# EAGLE schematic Backplane (EAGLE 7.2.0) (continued)
### Nets (continued)

### Notes on the sheet
- Distrabution
- IS | SS | ECU | TS

## Sheet 3 of 4
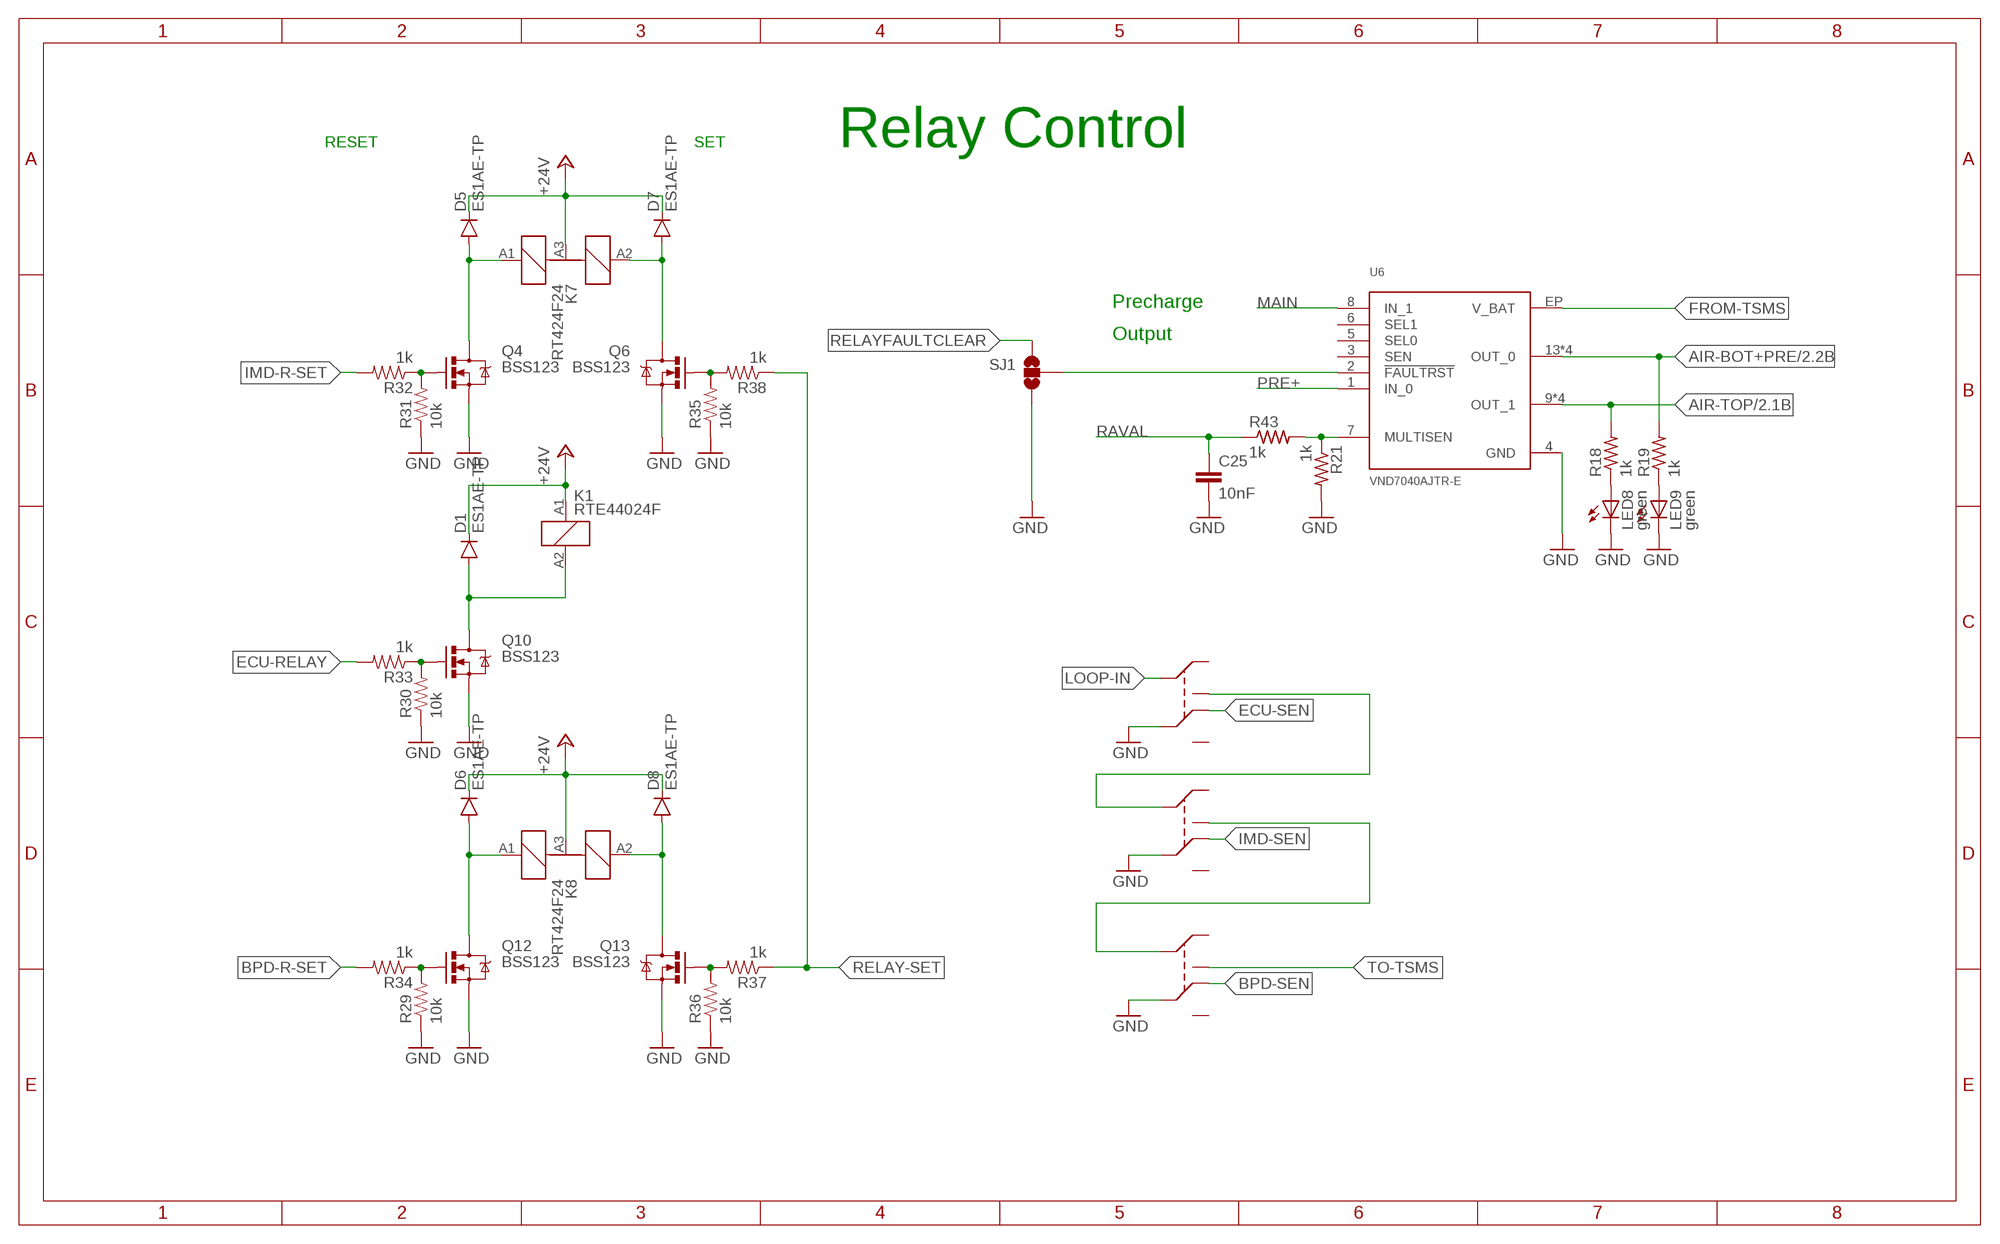
[diagram p3: schematic, sheet 3]

### Parts
C25  10nF  CAP0805  [0805]
D1  ES1AE-TP  DIODESMA-KIT  [SMA-DIODE-KIT]
D5  ES1AE-TP  DIODESMA-KIT  [SMA-DIODE-KIT]
D6  ES1AE-TP  DIODESMA-KIT  [SMA-DIODE-KIT]
D7  ES1AE-TP  DIODESMA-KIT  [SMA-DIODE-KIT]
D8  ES1AE-TP  DIODESMA-KIT  [SMA-DIODE-KIT]
K1  RTE44024F  [RTE44024F]
K7  RT424F24  [RT424F24]
K8  RT424F24  [RT424F24]
LED8  green  LEDCHIP-LED0805  [CHIP-LED0805]
LED9  green  LEDCHIP-LED0805  [CHIP-LED0805]
Q4  BSS123  MOSFET-NCHANNELBSS123LT1G  [SOT23-3]
Q6  BSS123  MOSFET-NCHANNELBSS123LT1G  [SOT23-3]
Q10  BSS123  MOSFET-NCHANNELBSS123LT1G  [SOT23-3]
Q12  BSS123  MOSFET-NCHANNELBSS123LT1G  [SOT23-3]
Q13  BSS123  MOSFET-NCHANNELBSS123LT1G  [SOT23-3]
R18  1k  R-US_R0805  [R0805]
R19  1k  R-US_R0805  [R0805]
R21  1k  R-US_R0805  [R0805]
R29  10k  RESISTOR0805-RES  [0805]
R30  10k  RESISTOR0805-RES  [0805]
R31  10k  RESISTOR0805-RES  [0805]
R32  1k  RESISTOR0805-RES  [0805]
R33  1k  RESISTOR0805-RES  [0805]
R34  1k  RESISTOR0805-RES  [0805]
R35  10k  RESISTOR0805-RES  [0805]
R36  10k  RESISTOR0805-RES  [0805]
R37  1k  RESISTOR0805-RES  [0805]
R38  1k  RESISTOR0805-RES  [0805]
R43  1k  R-US_R0805  [R0805]
SJ1  JUMPER-PAD-3-NOFULL_BOX_SILK  [PAD-JUMPER-3-NO_YES_SILK_FULL_BOX]
U6  VND7040AJTR-E  [SSO-16-POWER]

### Nets
+24V: D1.C D5.C D6.C D7.C D8.C K1.A1(+) K7.A3(-) K8.A3(-) ; also sheet 1,2,4
AIR-BOT+PRE: R19.2 U6.13(OUT_0) U6.14(OUT_0) U6.15(OUT_0) U6.16(OUT_0) ; also sheet 2
AIR-TOP: R18.2 U6.9(OUT_1) U6.10(OUT_1) U6.11(OUT_1) U6.12(OUT_1) ; also sheet 2
BPD-R-SET: R34.2 ; also sheet 2
BPD-SEN: K8.22(NC2) ; also sheet 2
ECU-RELAY: R33.2 ; also sheet 2
ECU-SEN: K1.22(NC2) ; also sheet 2
FROM-TSMS: U6.EP(V_BAT) ; also sheet 2
GND: C25.2 K1.21(C2) K7.21(C2) K8.21(C2) LED8.C LED9.C Q4.2(S) Q6.2(S) Q10.2(S) Q12.2(S) Q13.2(S) R21.2 R29.1 R30.1 R31.1 R35.1 R36.1 SJ1.3 U6.4(GND) ; also sheet 1,2,4
IMD-R-SET: R32.2 ; also sheet 2
IMD-SEN: K7.22(NC2) ; also sheet 2
LOOP-IN: K1.11(C1) ; also sheet 2
MAIN: U6.8(IN_1) ; also sheet 2
N$2: LED8.A R18.1
N$6: Q4.1(G) R31.2 R32.1
N$7: K1.14(NO1) K7.11(C1)
N$10: LED9.A R19.1
N$11: R21.1 R43.2 U6.7(MULTISEN)
N$14: SJ1.2 U6.2(!FAULTRST)
N$15: K7.14(NO1) K8.11(C1)
N$23: Q6.1(G) R35.2 R38.2
N$45: D1.A K1.A2(-) Q10.3(D)
N$47: D5.A K7.A1(+1) Q4.3(D)
N$48: Q10.1(G) R30.2 R33.1
N$49: D7.A K7.A2(+2) Q6.3(D)
N$50: D6.A K8.A1(+1) Q12.3(D)
N$51: D8.A K8.A2(+2) Q13.3(D)
N$55: Q13.1(G) R36.2 R37.2
N$58: Q12.1(G) R29.2 R34.1
PRE+: U6.1(IN_0) ; also sheet 2
RAVAL: C25.1 R43.1
RELAY-SET: R37.1 R38.1 ; also sheet 2
RELAYFAULTCLEAR: SJ1.1
TO-TSMS: K8.14(NO1) ; also sheet 2
Unconnected: K1.12(NC1) K1.24(NO2) K7.12(NC1) K7.24(NO2) K8.12(NC1) K8.24(NO2) U6.3(SEN) U6.5(SEL0) U6.6(SEL1)

### Notes on the sheet
- RESET | SET | Relay Control
- Precharge
- Output

## Sheet 4 of 4
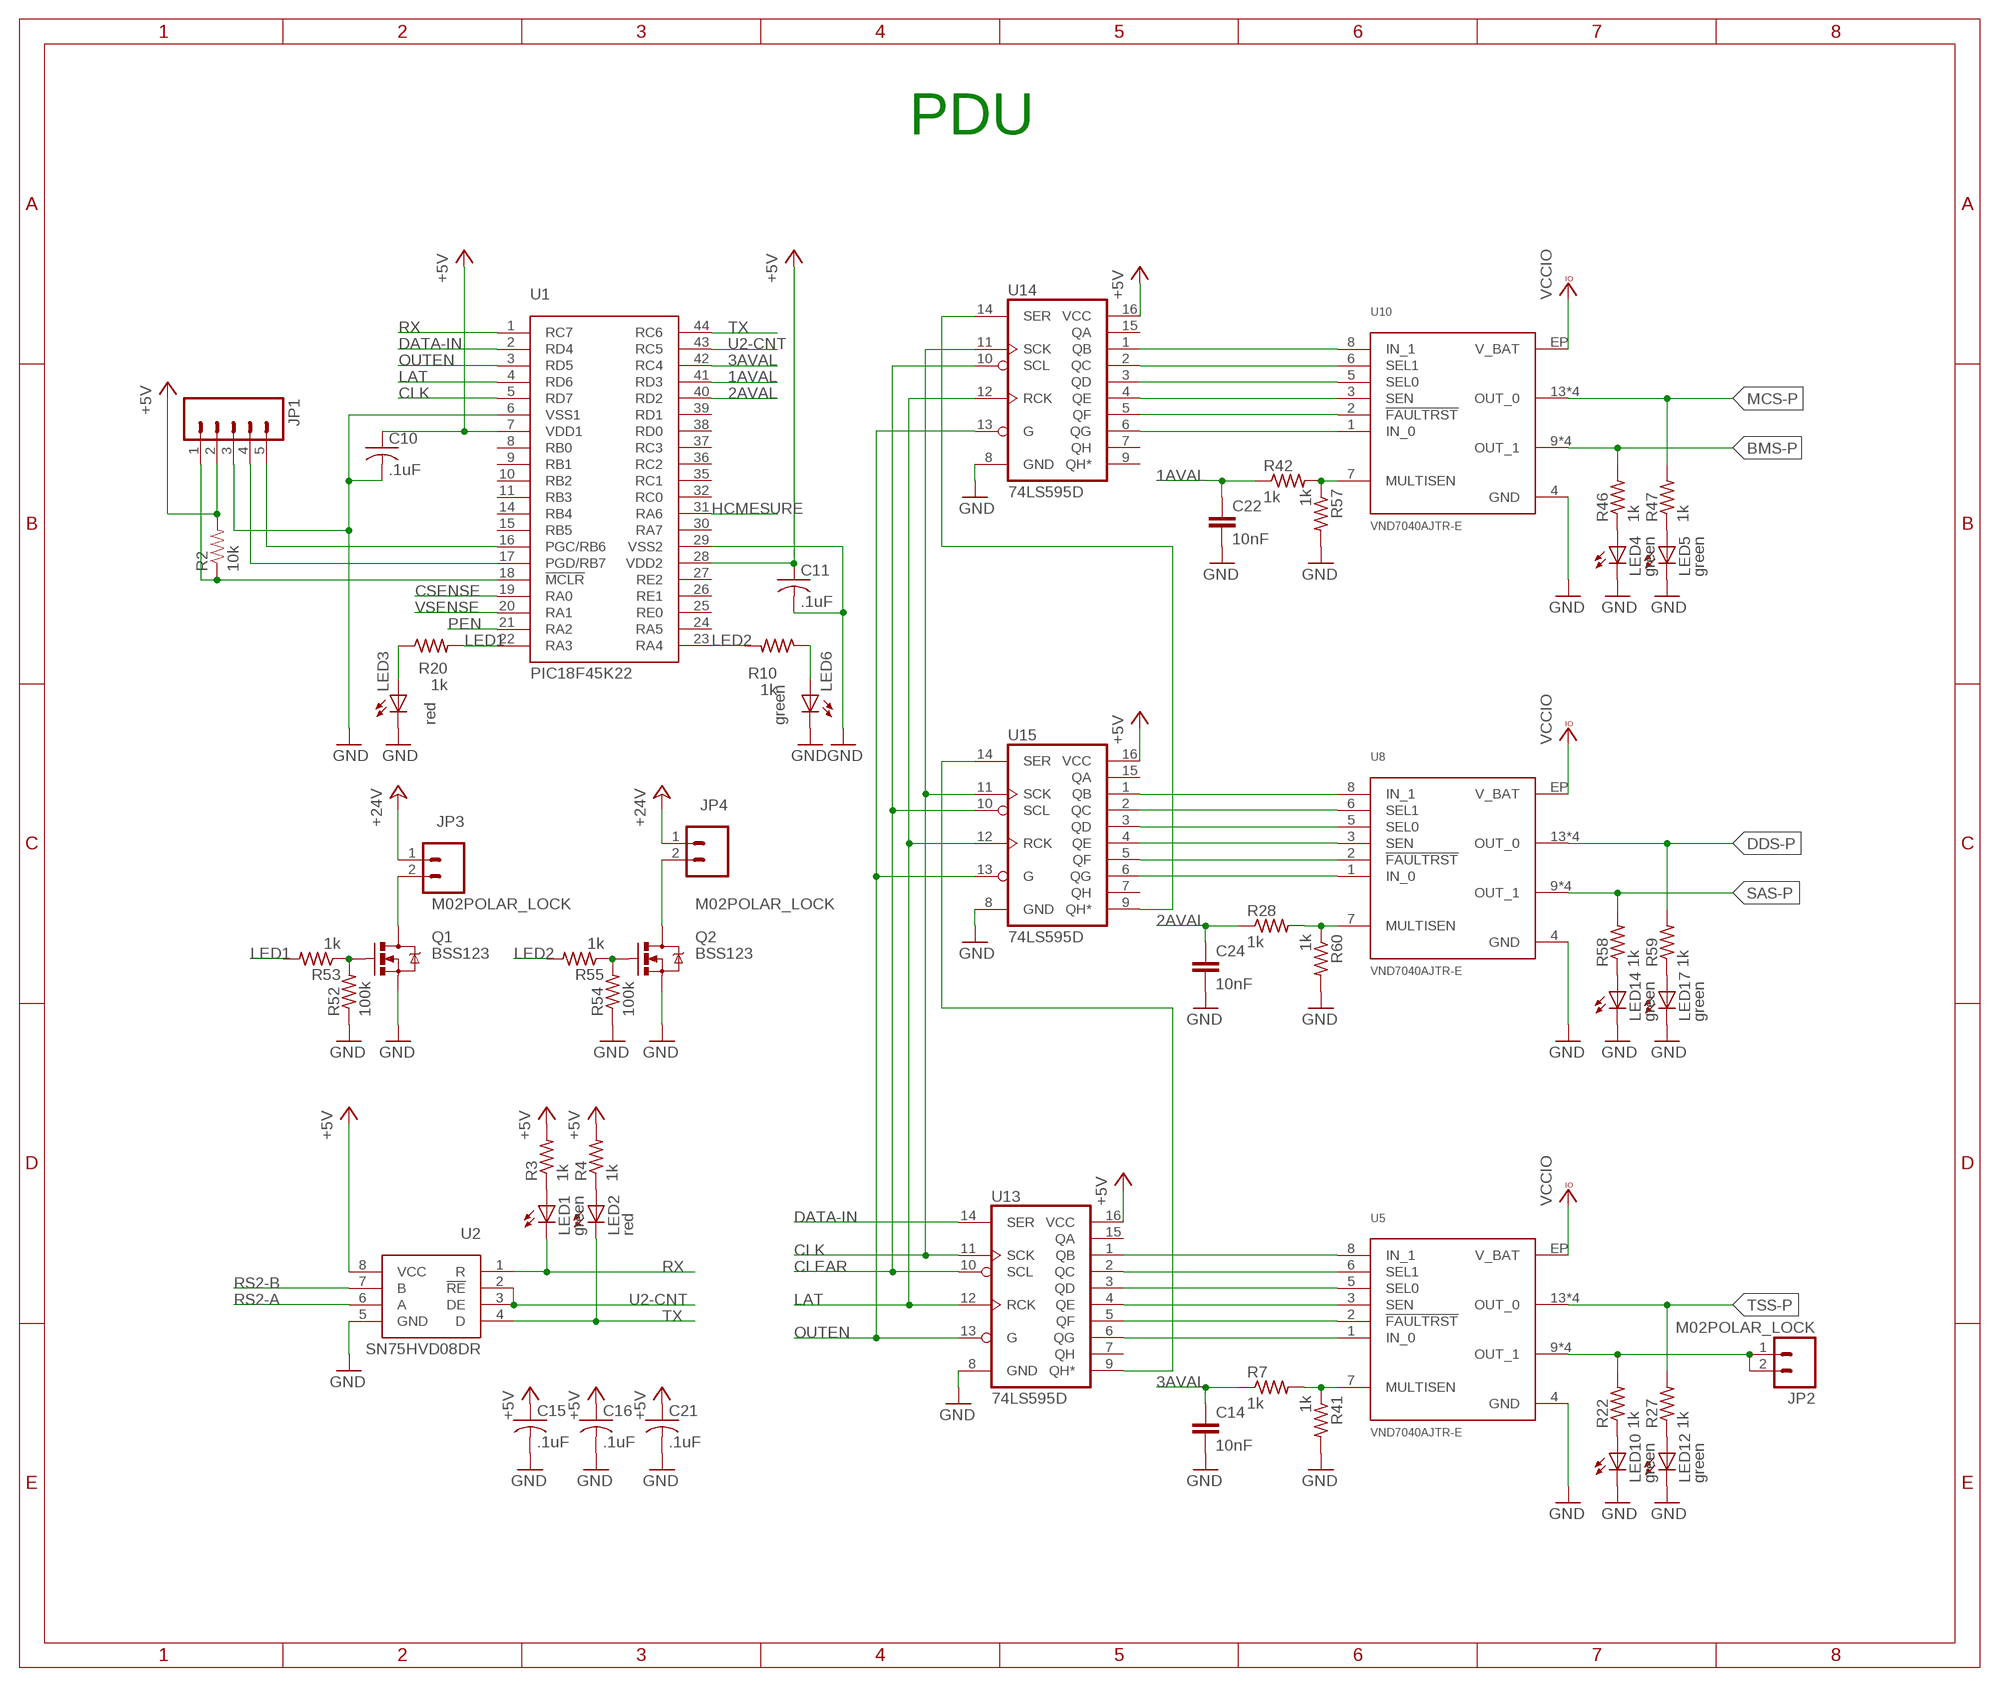
[diagram p4: schematic, sheet 4]

### Parts
C10  .1uF  C-USC0805  [C0805]
C11  .1uF  C-USC0805  [C0805]
C14  10nF  CAP0805  [0805]
C15  .1uF  C-USC0805  [C0805]
C16  .1uF  C-USC0805  [C0805]
C21  .1uF  C-USC0805  [C0805]
C22  10nF  CAP0805  [0805]
C24  10nF  CAP0805  [0805]
JP1  M05LOCK_LONGPADS  [1X05_LOCK_LONGPADS]
JP2  M02POLAR_LOCK  [MOLEX-1X2_LOCK]
JP3  M02POLAR_LOCK  [MOLEX-1X2_LOCK]
JP4  M02POLAR_LOCK  [MOLEX-1X2_LOCK]
LED1  green  LEDCHIP-LED0805  [CHIP-LED0805]
LED2  red  LEDCHIP-LED0805  [CHIP-LED0805]
LED3  red  LEDCHIP-LED0805  [CHIP-LED0805]
LED4  green  LEDCHIP-LED0805  [CHIP-LED0805]
LED5  green  LEDCHIP-LED0805  [CHIP-LED0805]
LED6  green  LEDCHIP-LED0805  [CHIP-LED0805]
LED10  green  LEDCHIP-LED0805  [CHIP-LED0805]
LED12  green  LEDCHIP-LED0805  [CHIP-LED0805]
LED14  green  LEDCHIP-LED0805  [CHIP-LED0805]
LED17  green  LEDCHIP-LED0805  [CHIP-LED0805]
Q1  BSS123  MOSFET-NCHANNELBSS123LT1G  [SOT23-3]
Q2  BSS123  MOSFET-NCHANNELBSS123LT1G  [SOT23-3]
R2  10k  RESISTOR0805-RES  [0805]
R3  1k  R-US_R0805  [R0805]
R4  1k  R-US_R0805  [R0805]
R7  1k  R-US_R0805  [R0805]
R10  1k  R-US_R0805  [R0805]
R20  1k  R-US_R0805  [R0805]
R22  1k  R-US_R0805  [R0805]
R27  1k  R-US_R0805  [R0805]
R28  1k  R-US_R0805  [R0805]
R41  1k  R-US_R0805  [R0805]
R42  1k  R-US_R0805  [R0805]
R46  1k  R-US_R0805  [R0805]
R47  1k  R-US_R0805  [R0805]
R52  100k  R-US_R0805  [R0805]
R53  1k  R-US_R0805  [R0805]
R54  100k  R-US_R0805  [R0805]
R55  1k  R-US_R0805  [R0805]
R57  1k  R-US_R0805  [R0805]
R58  1k  R-US_R0805  [R0805]
R59  1k  R-US_R0805  [R0805]
R60  1k  R-US_R0805  [R0805]
U1  PIC18F45K22  [TQFP-44]
U2  SN75HVD08DR  [SO-8]
U5  VND7040AJTR-E  [SSO-16-POWER]
U8  VND7040AJTR-E  [SSO-16-POWER]
U10  VND7040AJTR-E  [SSO-16-POWER]
U13  74LS595D  [SO16]
U14  74LS595D  [SO16]
U15  74LS595D  [SO16]

### Nets
1AVAL: C22.1 R42.1 U1.41(RD3)
2AVAL: C24.1 R28.1 U1.40(RD2)
3AVAL: C14.1 R7.1 U1.42(RC4)
+5V: C10.1 C11.1 C15.1 C16.1 C21.1 JP1.2 R2.2 R3.2 R4.2 U1.7(VDD1) U1.28(VDD2) U2.8(VCC) U13.16(VCC) U14.16(VCC) U15.16(VCC) ; also sheet 1,2
+24V: JP3.1 JP4.1 ; also sheet 1,2,3
BMS-P: R46.2 U10.9(OUT_1) U10.10(OUT_1) U10.11(OUT_1) U10.12(OUT_1) ; also sheet 2
CLEAR: U13.10(SCL) U14.10(SCL) U15.10(SCL)
CLK: U1.5(RD7) U13.11(SCK) U14.11(SCK) U15.11(SCK)
CSENSE: U1.19(RA0) ; also sheet 1
DATA-IN: U1.2(RD4) U13.14(SER)
DDS-P: R59.2 U8.13(OUT_0) U8.14(OUT_0) U8.15(OUT_0) U8.16(OUT_0) ; also sheet 2
GND: C10.2 C11.2 C14.2 C15.2 C16.2 C21.2 C22.2 C24.2 JP1.3 LED3.C LED4.C LED5.C LED6.C LED10.C LED12.C LED14.C LED17.C Q1.2(S) Q2.2(S) R41.2 R52.1 R54.1 R57.2 R60.2 U1.6(VSS1) U1.29(VSS2) U2.5(GND) U5.4(GND) U8.4(GND) U10.4(GND) U13.8(GND) U14.8(GND) U15.8(GND) ; also sheet 1,2,3
HCMESURE: U1.31(RA6) ; also sheet 1
LAT: U1.4(RD6) U13.12(RCK) U14.12(RCK) U15.12(RCK)
LED1: R20.2 R53.2 U1.22(RA3)
LED2: R10.2 R55.2 U1.23(RA4)
MCS-P: R47.2 U10.13(OUT_0) U10.14(OUT_0) U10.15(OUT_0) U10.16(OUT_0) ; also sheet 2
N$4: U10.8(IN_1) U14.1(QB)
N$16: LED3.A R20.1
N$17: JP2.1 JP2.2 R22.2 U5.9(OUT_1) U5.10(OUT_1) U5.11(OUT_1) U5.12(OUT_1)
N$21: JP3.2 Q1.3(D)
N$22: JP4.2 Q2.3(D)
N$24: LED1.A R3.1
N$25: LED2.A R4.1
N$26: Q1.1(G) R52.2 R53.1
N$27: Q2.1(G) R54.2 R55.1
N$28: LED10.A R22.1
N$29: LED12.A R27.1
N$31: R7.2 R41.1 U5.7(MULTISEN)
N$33: U10.6(SEL1) U14.2(QC)
N$36: U10.5(SEL0) U14.3(QD)
N$39: U10.3(SEN) U14.4(QE)
N$40: JP1.4 U1.17(PGD/RB7)
N$43: JP1.5 U1.16(PGC/RB6)
N$44: U10.2(!FAULTRST) U14.5(QF)
N$46: JP1.1 R2.1 U1.18(!MCLR)
N$54: LED6.A R10.1
N$62: U10.1(IN_0) U14.6(QG)
N$64: U8.8(IN_1) U15.1(QB)
N$65: U8.6(SEL1) U15.2(QC)
N$66: U8.5(SEL0) U15.3(QD)
N$67: LED4.A R46.1
N$68: LED5.A R47.1
N$69: R42.2 R57.1 U10.7(MULTISEN)
N$70: U8.3(SEN) U15.4(QE)
N$71: U8.2(!FAULTRST) U15.5(QF)
N$72: U8.1(IN_0) U15.6(QG)
N$73: U5.8(IN_1) U13.1(QB)
N$74: U5.6(SEL1) U13.2(QC)
N$75: U5.5(SEL0) U13.3(QD)
N$76: U5.3(SEN) U13.4(QE)
N$77: U5.2(!FAULTRST) U13.5(QF)
N$78: U5.1(IN_0) U13.6(QG)
N$79: U13.9(QH*) U15.14(SER)
N$80: U14.14(SER) U15.9(QH*)
N$83: LED14.A R58.1
N$84: LED17.A R59.1
N$85: R28.2 R60.1 U8.7(MULTISEN)
OUTEN: U1.3(RD5) U13.13(G) U14.13(G) U15.13(G)
PEN: U1.21(RA2)
RS2-A: U2.6(A) ; also sheet 2
RS2-B: U2.7(B) ; also sheet 2
RX: LED1.C U1.1(RC7) U2.1(R)
SAS-P: R58.2 U8.9(OUT_1) U8.10(OUT_1) U8.11(OUT_1) U8.12(OUT_1) ; also sheet 2
TSS-P: R27.2 U5.13(OUT_0) U5.14(OUT_0) U5.15(OUT_0) U5.16(OUT_0) ; also sheet 2
TX: LED2.C U1.44(RC6) U2.4(D)
U2-CNT: U1.43(RC5) U2.2(!RE) U2.3(DE)
VCCIO: U5.EP(V_BAT) U8.EP(V_BAT) U10.EP(V_BAT) ; also sheet 1
VSENSE: U1.20(RA1) ; also sheet 1
Unconnected: U1.8(RB0) U1.9(RB1) U1.10(RB2) U1.11(RB3) U1.14(RB4) U1.15(RB5) U1.24(RA5) U1.25(RE0) U1.26(RE1) U1.27(RE2) U1.30(RA7) U1.32(RC0) U1.35(RC1) U1.36(RC2) U1.37(RC3) U1.38(RD0) U1.39(RD1) U13.7(QH) U13.15(QA) U14.7(QH) U14.9(QH*) U14.15(QA) U15.7(QH) U15.15(QA)

### Notes on the sheet
- PDU

## Library data of the parts
5V 9V LED1-LED6 LED8-LED12 LED14 LED17 VCCIO VIN = adafruit:LED: LED OSRAM: - CHIPLED LG R971, LG N971, LY N971, LG Q971, LY Q971, LO R971, LY R971 LH N974, LH R974 LS Q976, LO Q976, LY Q976 LO Q996 - Hyper CHIPLED LW Q18S LB Q993, LB Q99A, LB R99A - SideLED LS A670, LO A670, LY A670, LG A670, LP A670 LB A673, LV A673, LT A673, LW A673 LH A674 LY A675 LS A676, LA A676, LO A676, LY A676, LW A676 LS A679, LY A679, LG A679 - Hyper Micro SIDELED® LS Y876, LA Y876, LO Y876, LY Y876 LT Y87S - SmartLED LW L88C, LW L88S LB L89C, LB L89S, LG L890 LS L89K, LO L89K, LY L89K LS L896, LA L896, LO L896, LY L896 - TOPLED LS T670, LO T670, LY T670, LG T670, LP T670 LSG T670, LSP T670, LSY T670, LOP T670, LYG T670 LG T671, LOG T671, LSG T671 LB T673, LV T673, LT T673, LW T673 LH T674 LS T676, LA T676, LO T676, LY T676, LB T676, LH T676, LSB T676, LW T676 LB T67C, LV T67C, LT T67C, LS T67K, LO T67K, LY T67K, LW E67C LS E67B, LA E67B, LO E67B, LY E67B, LB E67C, LV E67C, LT E67C LW T67C LS T679, LY T679, LG T679 LS T770, LO T770, LY T770, LG T770, LP T770 LB T773, LV T773, LT T773, LW T773 LH T774 LS E675, LA E675, LY E675, LS T675 LS T776, LA T776, LO T776, LY T776, LB T776 LHGB T686 LT T68C, LB T68C - Hyper Mini TOPLED® LB M676 - Mini TOPLED Santana® LG M470 LS M47K, LO M47K, LY M47K Source: http://www.osram.convergy.de/
C1 C4 C7 C8 C12 = SparkFun-Passives:CAP_POL: Capacitor Polarized These are standard SMD and PTH capacitors. Normally 10uF, 47uF, and 100uF in electrolytic and tantalum varieties. Always verify the external diameter of the through hole cap, it varies with capacity, voltage, and manufacturer. The EIA devices should be standard.
C2 C3 C9 = SparkFun-Capacitors:CAP: Capacitor Standard 0603 ceramic capacitor, and 0.1" leaded capacitor.
C5 C13 C14 C18-C20 C22 C24-C28 = SparkFun-Passives:CAP: Capacitor Standard 0603 ceramic capacitor, and 0.1" leaded capacitor.
C6 C17 = adafruit:CPOL-US: POLARIZED CAPACITOR, American symbol
C10 C11 C15 C16 C21 C23 = adafruit:C-US: CAPACITOR, American symbol
D1 D5-D8 = SparkFun-DiscreteSemi:DIODE: Diode These are standard reverse protection diodes and small signal diodes. SMA package can handle up to about 1A. SOD-323 can handle about 200mA. What the SOD-323 package when ordering, there are some mfgs out there that are 5-pin packages.
D3 = NASA_LIB:TVS
D9 = SparkFun:DIODE-ZENER: Zener Diode Production Part - 8199 3.4V Zener Voltage
F1-F4 = SparkFun-PowerIC:PTC: Resettable Fuse PTC Resettable Fuse. Spark Fun Electronics SKU : COM-08357; PROD_ID: RES-11150
J1 = FSAE Eletric:M23
J2 = FSAE Eletric:M35
JP1 = SparkFun-Connectors:M05: Header 5 Standard 5-pin 0.1" header. Use with straight break away headers (SKU : PRT-00116), right angle break away headers (PRT-00553), swiss pins (PRT-00743), machine pins (PRT-00117), and female headers (PRT-00115). Molex polarized connector foot print use with SKU : PRT-08230 with associated crimp pins and housings.
JP2-JP4 = SparkFun-Connectors:M02: Standard 2-pin 0.1" header. Use with - straight break away headers ( PRT-00116) - right angle break away headers (PRT-00553) - swiss pins (PRT-00743) - machine pins (PRT-00117) - female headers (PRT-00115) Molex polarized connector foot print use with: PRT-08233 with associated crimp pins and housings. 2.54_SCREWTERM for use with PRT-10571. 3.5mm Screw Terminal footprints for PRT-08084 5mm Screw Terminal footprints for use with PRT-08432
JP5 = SparkFun-Connectors:M08: Header 8 Standard 8-pin 0.1" header. Use with straight break away headers (SKU : PRT-00116), right angle break away headers (PRT-00553), swiss pins (PRT-00743), machine pins (PRT-00117), and female headers (PRT-00115).
JP7 = SparkFun-Connectors:M04: Header 4 Standard 4-pin 0.1" header. Use with straight break away headers (SKU : PRT-00116), right angle break away headers (PRT-00553), swiss pins (PRT-00743), machine pins (PRT-00117), and female headers (PRT-00115). Molex polarized connector foot print use with SKU : PRT-08231 with associated crimp pins and housings. 1MM SMD Version SKU: PRT-10208
K1 = FSAE Eletric:RTE44024F
K7 K8 = FSAE Eletric:RT424F24
L1 = FSAE Eletric:ACM1513-551-2PL-TL
Q1 Q2 Q4 Q6 Q10 Q12 Q13 = SparkFun-DiscreteSemi:MOSFET-NCHANNEL: Common NMOSFET Parts MFG P/NStore IDProd ID FDD8780TRANS-09984 SI7820DNTRANS-11055 FDS6630AIC-08089 2N7002PWTRANS-11151 FQP30N06L COM-10213TRANS-10060 BSS123LT1GTRANS-08345 BSS138TRANS-00830 BS170 2N7000; PROD_ID: TRANS-08345
Q7 = SparkFun-DiscreteSemi:MOSFET-PCHANNEL-SOIC8: Generic 8-pin PMOSFET
QE4 = DFT:BSS123
R1 R3-R10 R13-R15 R18-R22 R24-R28 R39-R43 R46 R47 R52-R60 = adafruit:R-US_: RESISTOR, American symbol
R2 R11 R12 R16 R17 R23 R29-R38 R44 R45 R48-R51 = SparkFun-Passives:RESISTOR: Resistor Basic schematic elements and footprints for 0603, 1206, and PTH resistors.
R61-R63 = SparkFun:RESISTOR: Resistor Basic schematic elements and footprints for 0603, 1206, and PTH resistors.
SJ1 = SparkFun-Passives:JUMPER-PAD-3-NO
STANDOFF1-STANDOFF5 = SparkFun-Electromechanical:STAND-OFF: #4 Stand Off This is the mechanical footprint for a #4 phillips button head screw. Use the keepout ring to avoid running the screw head into surrounding components. SKU : PRT-00447
U1 = FSAE Eletric:PIC18F45K22
U2 = FSAE Eletric:SN75HVD08DR
U3 U11 = FSAE Eletric:ACS712
U5 U6 U8 U10 = FSAE Eletric:VND7040AJTR-E
U7 = FSAE Eletric:FAN3278TMX
U9 U12 = NASA_LIB:APXW005A0X43-SRZ
U13-U15 = SparkFun-DigitalIC:74*595: 8-bit SHIFT REGISTER, output latch; PROD_ID: IC-07875
U$1 U$4-U$6 = FSAE Eletric:CARD-SLOT
U$2 = SparkFun-PowerIC:LM2931: LDO regulator with reverse battery protection- very durable!
U$3 = Pic:BEER
U$7 = Pic:LOGO
U$8 = SparkFun:OSHW-LOGO: Open Source Hardware Logo This logo indicates the piece of hardware it is found on incorporates a OSHW license and/or adheres to the definition of open source hardware found here: http://freedomdefined.org/OSHW
U$9 = FSAE Eletric:IND
V1 = SparkFun:VARISTOR: Varistor Varistor (Variable resistor) is a nonlinear resistive element of the voltage dependence that resistance changes with applied voltage. Varistor is equivalent with Zener diode of two series connection.
X1 X2 = con-molex:5566-4: Mini FIT connector 4 pol Source: http://www.molex.com; OC_FARNELL: unknown; OC_NEWARK: unknown

## Net classes
1 power: width 0.61 mm, drill 0.711 mm, clearance 0.203 mm